# Altium schematic sheet PowerSupply.SchDoc: Evaluation Board 3.2
size A3; Organization: Toradex AG; Address1: Altsagenstrasse 5; Address2: Horw; Address3: 6048; Address4: Switzerland; DocumentNumber: 4; Revision: V3.2; SheetNumber: 4; SheetTotal: 23; PageSetup: Record=PageOptions|CenterHorizontal=True|CenterVertical=True|PrintScale=0.73|XCorrection=1.00|YCorrection=1.00|PrintKind=0|BorderSize=5000000|LeftOffset=0|BottomOffset=0|Orientation=2|PaperLength=1000|PaperWidth=1000|Scale=100|PaperSource=7|PrintQuality=-4|MediaType=1|DitherType=10|PaperKind=A4|PrintScaleMode=1
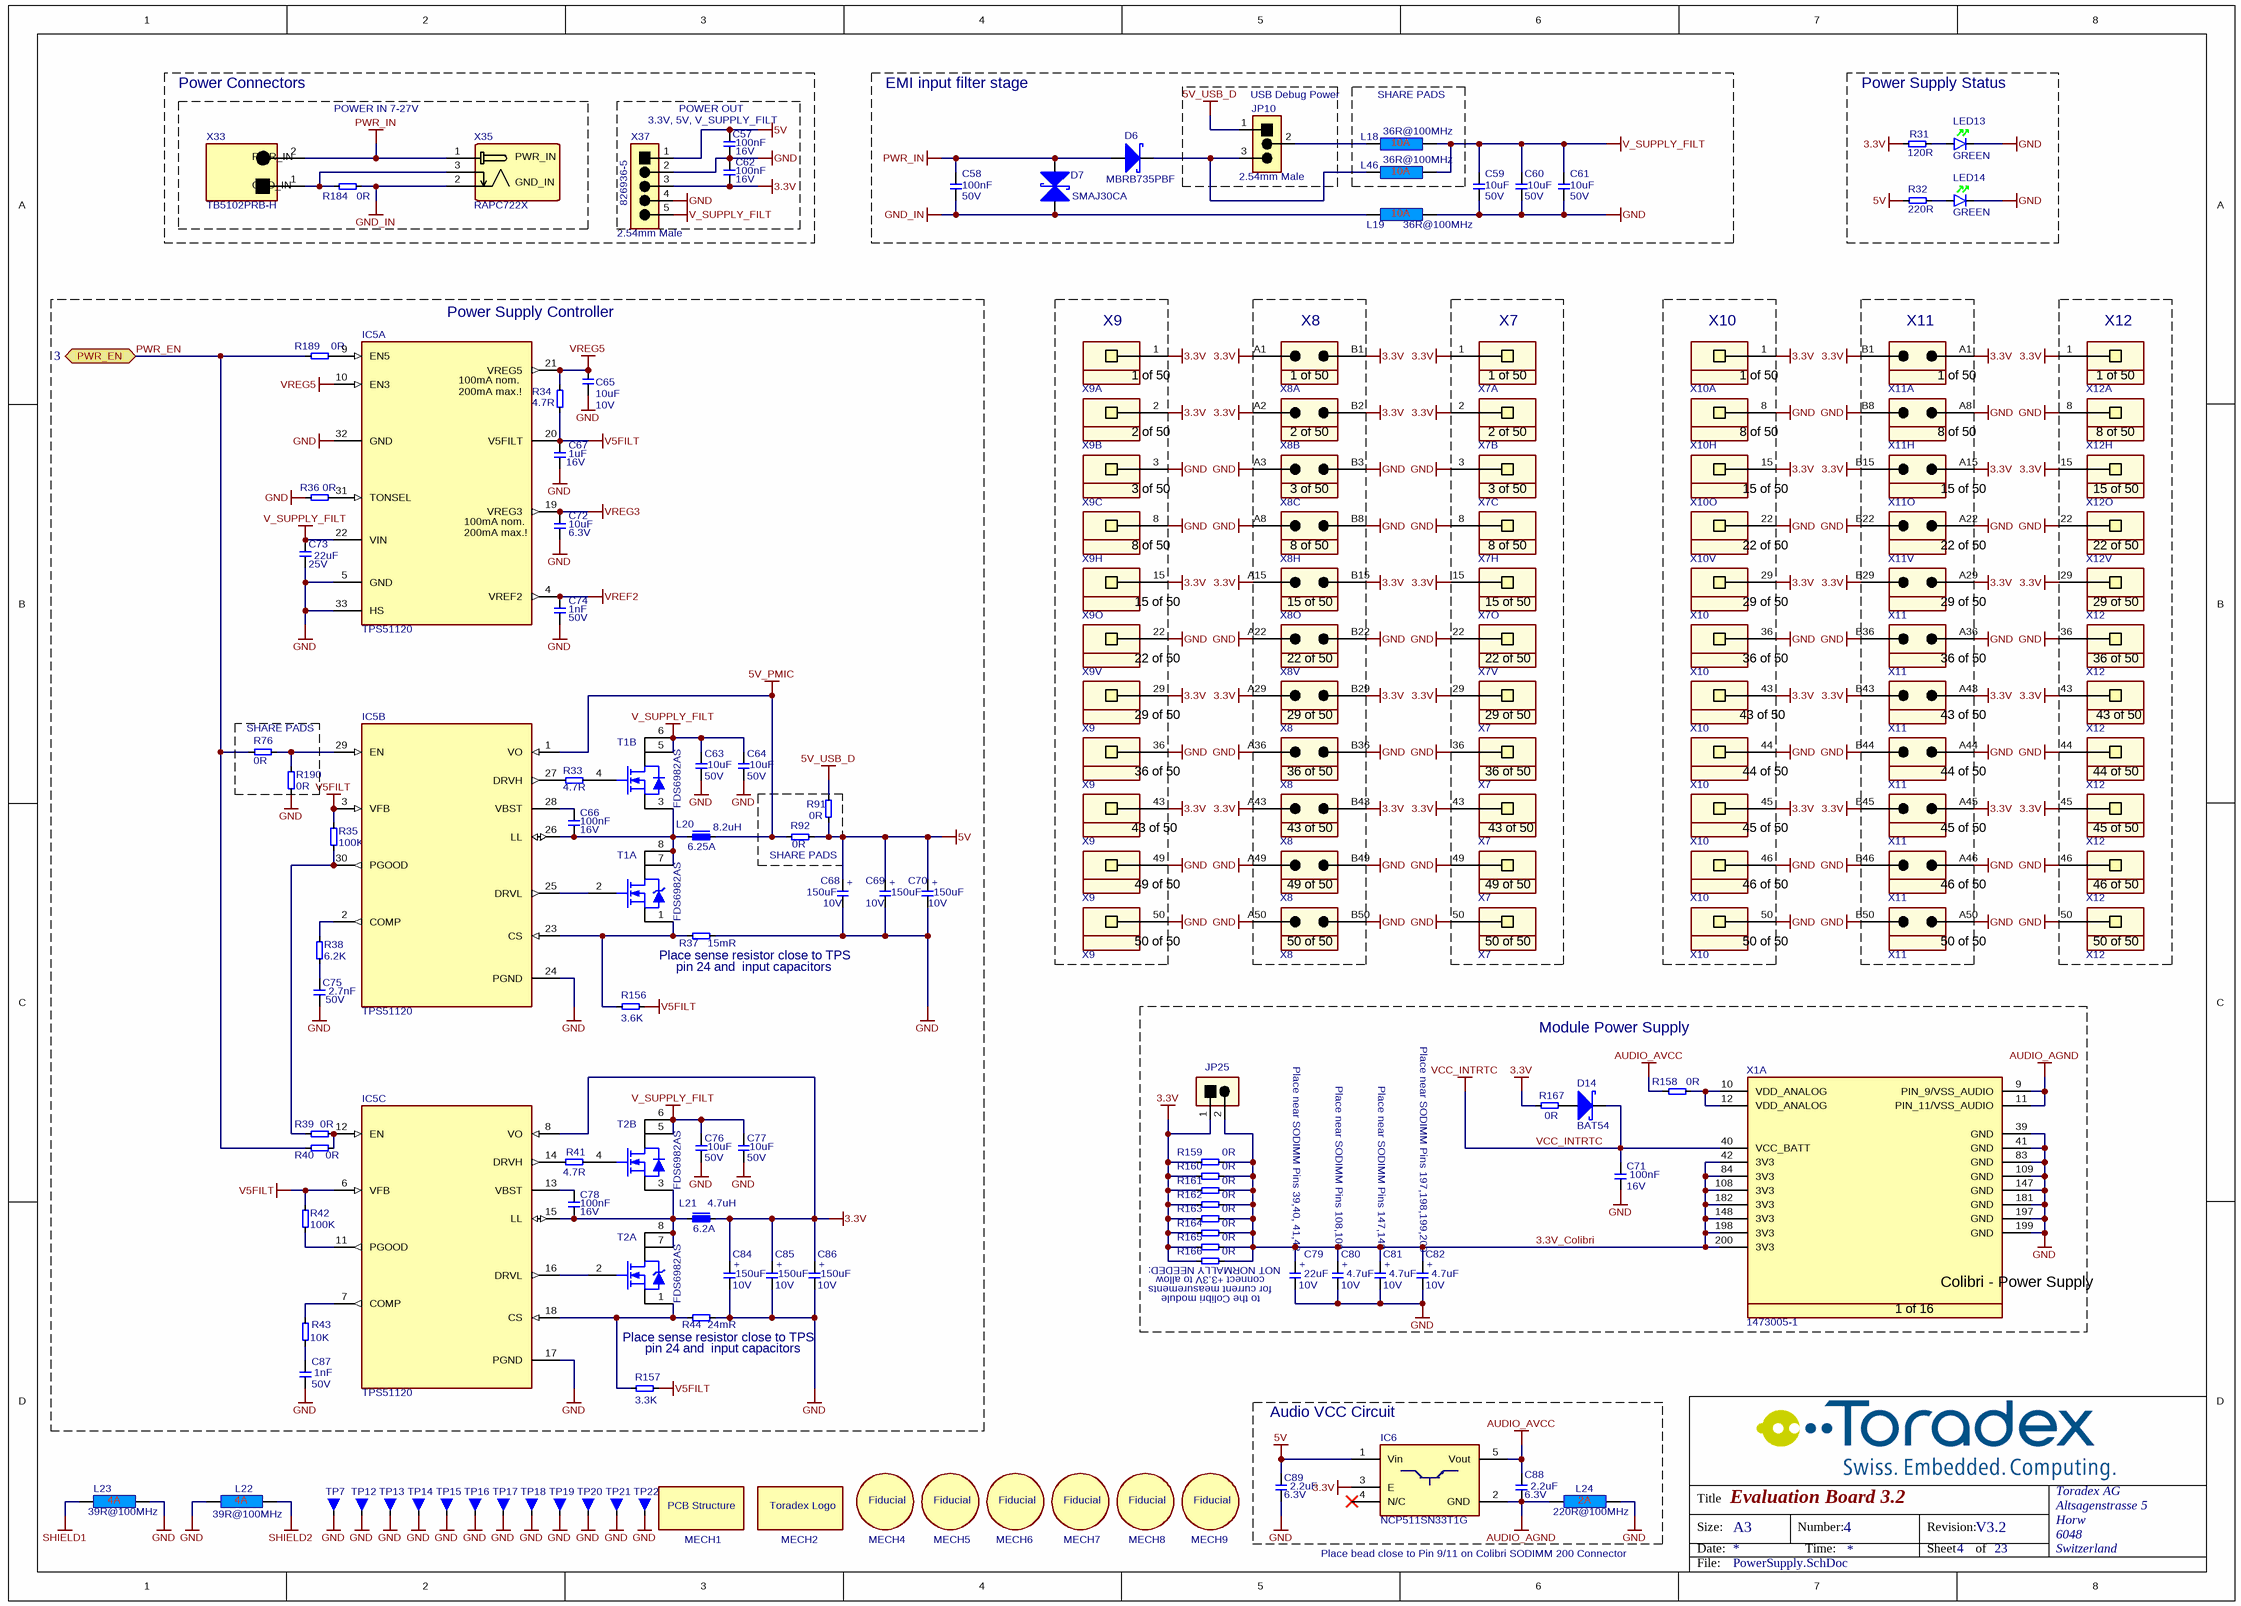
[diagram p0: PowerSupply.SchDoc]

## Parts
C57  Rating: 16V  [T_CAPC0603X33N]  (hidden comment: 100nF)
C58  Rating: 50V  [T_CAPC0603X33N]  (hidden comment: 100nF)
C59  Rating: 50V  [CAPC3225X160N]  (hidden comment: 10uF)
C60  Rating: 50V  [CAPC3225X160N]  (hidden comment: 10uF)
C61  Rating: 50V  [CAPC3225X160N]  (hidden comment: 10uF)
C62  Rating: 16V  [T_CAPC0603X33N]  (hidden comment: 100nF)
C63  Rating: 50V  [CAPC3225X160N]  (hidden comment: 10uF)
C64  Rating: 50V  [CAPC3225X160N]  (hidden comment: 10uF)
C65  Rating: 10V  [T_CAPC0805X125N]  (hidden comment: 10uF)
C66  Rating: 16V  [T_CAPC0603X33N]  (hidden comment: 100nF)
C67  Rating: 16V  [T_CAPC0603X33N]  (hidden comment: 1uF)
C68  Rating: 10V  [CAPMP7343X310N]  (hidden comment: 150uF)
C69  Rating: 10V  [CAPMP7343X310N]  (hidden comment: 150uF)
C70  Rating: 10V  [CAPMP7343X310N]  (hidden comment: 150uF)
C71  Rating: 16V  [T_CAPC0603X33N]  (hidden comment: 100nF)
C72  Rating: 6.3V  [T_CAPC0603X33N]  (hidden comment: 10uF)
C73  Rating: 25V  [CAPC3225X160N]  (hidden comment: 22uF)
C74  Rating: 50V  [T_CAPC0603X33N]  (hidden comment: 1nF)
C75  Rating: 50V  [CAPC1005X60N]  (hidden comment: 2.7nF)
C76  Rating: 50V  [CAPC3225X160N]  (hidden comment: 10uF)
C77  Rating: 50V  [CAPC3225X160N]  (hidden comment: 10uF)
C78  Rating: 16V  [T_CAPC0603X33N]  (hidden comment: 100nF)
C79  Rating: 10V  [CAPMP3528X210N]  (hidden comment: 22uF)
C80  Rating: 10V  [T_CAPMP3216X180N]  (hidden comment: 4.7uF)
C81  Rating: 10V  [T_CAPMP3216X180N]  (hidden comment: 4.7uF)
C82  Rating: 10V  [T_CAPMP3216X180N]  (hidden comment: 4.7uF)
C84  Rating: 10V  [CAPMP7343X310N]  (hidden comment: 150uF)
C85  Rating: 10V  [CAPMP7343X310N]  (hidden comment: 150uF)
C86  Rating: 10V  [CAPMP7343X310N]  (hidden comment: 150uF)
C87  Rating: 50V  [T_CAPC0603X33N]  (hidden comment: 1nF)
C88  Rating: 6.3V  [T_CAPC0603X33N]  (hidden comment: 2.2uF)
C89  Rating: 6.3V  [T_CAPC0603X33N]  (hidden comment: 2.2uF)
D6  MBRB735PBF  [T_VISHAY_MBRB735PBF]
D7  Manufacturer Part No.: SMAJ30CA  [T_LITTLEFUSE_SMAJ30CA]  (hidden comment: D-Littelfuse-SMAJ30CA-Schottky)
D14  BAT54  [SOT95P230X110-3N]
IC5  TPS51120  [QFN50P500X500X100-33N]  (parts A,B,C of 3)
IC6  NCP511SN33T1G  [SOT95P279X142-5N]
JP10  826936-3  [T_TYCO_826936-3]  (value not drawn)
JP25  TSW-101-07-G-D  [T_Samtec_TSW-101-07-G-D]  (value not drawn)
L18  36R@100MHz  [T_Laird_35F0121-0SR-10]
L19  36R@100MHz  [T_Laird_35F0121-0SR-10]
L20  Rating: 6.25A  [T_INDM120120X80N]  (hidden comment: 8.2uH)
L21  Rating: 6.2A  [T_INDM102102X45N]  (hidden comment: 4.7uH)
L22  39R@100MHz  [INDC2013X130N]
L23  39R@100MHz  [INDC2013X130N]
L24  220R@100MHz  [INDC1608X95N]
L46  36R@100MHz  [T_Laird_35F0121-0SR-10]
LED13  Color: GREEN  [T_Osram_T670_GREEN]  (hidden comment: LG T670-K1L2-1)
LED14  Color: GREEN  [T_Osram_T670_GREEN]  (hidden comment: LG T670-K1L2-1)
MECH1  MECH-PCB  [PCB]  (value not drawn)
MECH2  MECH-Toradex_Logo  [T_TORADEX_LOGO]  (value not drawn)
MECH4  MECH-Fiducial  [T_Fiducial]  (value not drawn)
MECH5  MECH-Fiducial  [T_Fiducial]  (value not drawn)
MECH6  MECH-Fiducial  [T_Fiducial]  (value not drawn)
MECH7  MECH-Fiducial  [T_Fiducial]  (value not drawn)
MECH8  MECH-Fiducial  [T_Fiducial]  (value not drawn)
MECH9  MECH-Fiducial  [T_Fiducial]  (value not drawn)
R31  120R  [T_RESC0603X30N]
R32  220R  [T_RESC0603X30N]
R33  4.7R  [RESC1005X40N]
R34  4.7R  [RESC1005X40N]
R35  100K  [T_RESC0603X30N]
R36  0R  [T_RESC0603X30N]
R37  15mR  [RESC3316X76N]
R38  6.2K  [RESC1005X40N]
R39  0R  [T_RESC0603X30N]
R40  0R  [T_RESC0603X30N]
R41  4.7R  [RESC1005X40N]
R42  100K  [T_RESC0603X30N]
R43  10K  [RESC1005X40N]
R44  24mR  [RESC3316X76N]
R76  0R  [T_RESC3216X760N]
R91  0R  [T_RESC3225X30N]
R92  0R  [T_RESC3225X30N]
R156  3.6K  [T_RESC0603X30N]
R157  3.3K  [T_RESC0603X30N]
R158  0R  [T_RESC0603X30N]
R159  0R  [T_RESC3216X760N]
R160  0R  [T_RESC3216X760N]
R161  0R  [T_RESC3216X760N]
R162  0R  [T_RESC3216X760N]
R163  0R  [T_RESC3216X760N]
R164  0R  [T_RESC3216X760N]
R165  0R  [T_RESC3216X760N]
R166  0R  [T_RESC3216X760N]
R167  0R  [T_RESC0603X30N]
R184  0R  [T_RESC3216X760N]
R189  0R  [T_RESC0603X30N]
R190  0R  [T_RESC3216X760N]
T1  FDS6982AS  [SOIC127P600X173-8N]  (parts A,B of 2)
T2  FDS6982AS  [SOIC127P600X173-8N]  (parts A,B of 2)
TP7  5011  [T_TP-THT - EYE]  (value not drawn)
TP12  5011  [T_TP-THT - EYE]  (value not drawn)
TP13  5011  [T_TP-THT - EYE]  (value not drawn)
TP14  5011  [T_TP-THT - EYE]  (value not drawn)
TP15  5011  [T_TP-THT - EYE]  (value not drawn)
TP16  5011  [T_TP-THT - EYE]  (value not drawn)
TP17  5011  [T_TP-THT - EYE]  (value not drawn)
TP18  5011  [T_TP-THT - EYE]  (value not drawn)
TP19  5011  [T_TP-THT - EYE]  (value not drawn)
TP20  5011  [T_TP-THT - EYE]  (value not drawn)
TP21  5011  [T_TP-THT - EYE]  (value not drawn)
TP22  5011  [T_TP-THT - EYE]  (value not drawn)
X1  Manufacturer Part No.: 1473005-1  [T_Tyco_1473005-1]  (hidden comment: CON-Tyco-1473005-1-200-0.6mm)  (part A of 16)
X7  SSW-110-01-G-S  [T_Samtec_SSW-110-01-G-S]  (value not drawn)  (parts A,B,C,H,O,V,29,36,43,49,50 of 50)
X8  TSW-110-07-G-D  [T_Samtec_TSW-110-07-G-D]  (value not drawn)  (parts A,B,C,H,O,V,29,36,43,49,50 of 50)
X9  SSW-110-01-G-S  [T_Samtec_SSW-110-01-G-S]  (value not drawn)  (parts A,B,C,H,O,V,29,36,43,49,50 of 50)
X10  SSW-110-01-G-S  [T_Samtec_SSW-110-01-G-S]  (value not drawn)  (parts A,H,O,V,29,36,43,44,45,46,50 of 50)
X11  TSW-110-07-G-D  [T_Samtec_TSW-110-07-G-D]  (value not drawn)  (parts A,H,O,V,29,36,43,44,45,46,50 of 50)
X12  SSW-110-01-G-S  [T_Samtec_SSW-110-01-G-S]  (value not drawn)  (parts A,H,O,V,29,36,43,44,45,46,50 of 50)
X33  TB5102PRB-H  [T_AUK_TB5102PRB-H]
X35  RAPC722X  [T_DCJ20-0014TB-L]
X37  826936-5  [T_TYCO_826936-5]

## Blocks framed on the sheet
EMI input filter stage: C58-C61 D6 D7 JP10 L19
Power Supply Status: LED13 LED14 R31 R32
Power Connectors: R184 X33 X35
SHARE PADS: L18 L46
Power Supply Controller: C63-C70 C72-C78 C84-C87 IC5 L20 L21 R33-R44 R156 R157 R189 T1 T2
X9: X9
X8: X8
X7: X7
X10: X10
X11: X11
X12: X12
SHARE PADS: R76 R190
SHARE PADS: R91 R92
Module Power Supply: C71 C79-C82 D14 JP25 R158-R167 X1
Audio VCC Circuit: C88 C89 IC6 L24

## Ports
PWR_EN (bidir, see 3)

## Nets
3.3V: C62.1 C84.1 C85.1 C86.1 IC5.8(VO) IC6.3(E) JP25.1 L21.2 R31.1 R159.1 R160.1 R161.1 R162.1 R163.1 R164.1 R165.1 R166.1 R167.1 X7.1 X7.2 X7.15 X7.29 X7.43 X8.A1 X8.A2 X8.A15 X8.A29 X8.A43 X8.B1 X8.B2 X8.B15 X8.B29 X8.B43 X9.1 X9.2 X9.15 X9.29 X9.43 X10.1 X10.15 X10.29 X10.43 X10.45 X11.A1 X11.A15 X11.A29 X11.A43 X11.A45 X11.B1 X11.B15 X11.B29 X11.B43 X11.B45 X12.1 X12.15 X12.29 X12.43 X12.45 X37.3
5V: C57.2 C68.1 C69.1 C70.1 C89.2 IC6.1(Vin) R32.1 R91.2 R92.2 X37.1
5V_PMIC: IC5.1(VO) L20.2 R92.1
5V_USB_D: JP10.1 R91.1
AUDIO_AGND: C88.1 IC6.2(GND) L24.1 X1.9(PIN_9/VSS_AUDIO) X1.11(PIN_11/VSS_AUDIO)
AUDIO_AVCC: C88.2 IC6.5(Vout) R158.1
GND: C57.1 C59.1 C60.1 C61.1 C62.2 C63.1 C64.1 C65.1 C67.1 C68.2 C69.2 C70.2 C71.1 C72.1 C73.1 C74.1 C75.1 C76.1 C77.1 C79.2 C80.2 C81.2 C82.2 C84.2 C85.2 C86.2 C87.1 C89.1 IC5.5(GND) IC5.17(PGND) IC5.24(PGND) IC5.32(GND) IC5.33(HS) L19.2 L22.1 L23.2 L24.2 LED13.K LED14.K R36.1 R37.2 R44.2 R190.1 TP7.1 TP12.1 TP13.1 TP14.1 TP15.1 TP16.1 TP17.1 TP18.1 TP19.1 TP20.1 TP21.1 TP22.1 X1.39(GND) X1.41(GND) X1.83(GND) X1.109(GND) X1.147(GND) X1.181(GND) X1.197(GND) X1.199(GND) X7.3 X7.8 X7.22 X7.36 X7.49 X7.50 X8.A3 X8.A8 X8.A22 X8.A36 X8.A49 X8.A50 X8.B3 X8.B8 X8.B22 X8.B36 X8.B49 X8.B50 X9.3 X9.8 X9.22 X9.36 X9.49 X9.50 X10.8 X10.22 X10.36 X10.44 X10.46 X10.50 X11.A8 X11.A22 X11.A36 X11.A44 X11.A46 X11.A50 X11.B8 X11.B22 X11.B36 X11.B44 X11.B46 X11.B50 X12.8 X12.22 X12.36 X12.44 X12.46 X12.50 X37.2 X37.4
GND_IN: C58.1 D7.2(Anode) L19.1 R184.2 X35.2(PWR_IN)
PWR_IN: C58.2 D6.3 D7.1(Cathode) X33.2(PWR_IN) X35.1(GND_IN)
SHIELD1: L23.1
SHIELD2: L22.2
V5FILT: C67.2 IC5.3(VFB) IC5.6(VFB) IC5.20(V5FILT) R34.1 R35.2 R42.2 R156.2 R157.2
V_SUPPLY_FILT: C59.2 C60.2 C61.2 C63.2 C64.2 C73.2 C76.2 C77.2 IC5.22(VIN) L18.2 L46.2 T1.5(D) T1.6(D) T2.5(D) T2.6(D) X37.5
VCC_INTRTC: C71.2 D14.3 X1.40(VCC_BATT)
VREF2: C74.2 IC5.4(VREF2)
VREG3: C72.2 IC5.19(VREG3)
VREG5: C65.2 IC5.10(EN3) IC5.21(VREG5) R34.2
3.3V_Colibri: C79.1 C80.1 C81.1 C82.1 JP25.2 R159.2 R160.2 R161.2 R162.2 R163.2 R164.2 R165.2 R166.2 X1.42(3V3) X1.84(3V3) X1.108(3V3) X1.148(3V3) X1.182(3V3) X1.198(3V3) X1.200(3V3)
PWR_EN: R40.1 R76.1 R189.1 ; port PWR_EN
NetC66_1: C66.1 IC5.26(LL) L20.1 T1.3(S) T1.7(D) T1.8(D)
NetC66_2: C66.2 IC5.28(VBST)
NetC75_2: C75.2 R38.1
NetC78_1: C78.1 IC5.15(LL) L21.1 T2.3(S) T2.7(D) T2.8(D)
NetC78_2: C78.2 IC5.13(VBST)
NetC87_2: C87.2 R43.1
NetD6_2: D6.2 JP10.3 L46.1
NetD14_1: D14.1 R167.2
NetIC5_2: IC5.2(COMP) R38.2
NetIC5_7: IC5.7(COMP) R43.2
NetIC5_9: IC5.9(EN5) R189.2
NetIC5_11: IC5.11(PGOOD) R42.1
NetIC5_12: IC5.12(EN) R39.2 R40.2
NetIC5_14: IC5.14(DRVH) R41.1
NetIC5_16: IC5.16(DRVL) T2.2(G)
NetIC5_18: IC5.18(CS) R44.1 R157.1 T2.1(S)
NetIC5_23: IC5.23(CS) R37.1 R156.1 T1.1(S)
NetIC5_25: IC5.25(DRVL) T1.2(G)
NetIC5_27: IC5.27(DRVH) R33.1
NetIC5_29: IC5.29(EN) R76.2 R190.2
NetIC5_30: IC5.30(PGOOD) R35.1 R39.1
NetIC5_31: IC5.31(TONSEL) R36.2
NetJP10_2: JP10.2 L18.1
NetLED13_A: LED13.A R31.2
NetLED14_A: LED14.A R32.2
NetR33_2: R33.2 T1.4(G)
NetR41_2: R41.2 T2.4(G)
NetR158_2: R158.2 X1.10(VDD_ANALOG) X1.12(VDD_ANALOG)
NetR184_1: R184.1 X33.1(GND_IN) X35.3(PWR_IN)

Not connected (* = marked no-connect by the designer): IC6 4(N/C)*

## Notes on the sheet
- POWER IN 7-27V
- (near C57) 3.3V, 5V, V_SUPPLY_FILT
- (near C57) POWER OUT
- (near JP10) USB Debug Power
- (near JP10) 2.54mm Male
- (near X37) 2.54mm Male
- (near R37) Place sense resistor close to TPS
- (near R37) pin 24 and  input capacitors
- Place near SODIMM Pins 197,198,199,200
- (near C79) Place near SODIMM Pins 39,40, 41,42
- Place near SODIMM Pins 108,109
- Place near SODIMM Pins 147,148
- (near R166) connect +3.3V to allow
- (near R166) NOT NORMALLY NEEDED:
- (near R44) Place sense resistor close to TPS
- to the Colibri module
- for current measurements
- pin 24 and  input capacitors
- Place bead close to Pin 9/11 on Colibri SODIMM 200 Connector
- Title
- Size:
- Date:
- A3
- Number:
- Time:
- Revision:
- Sheet
- of
- File:
- (in symbol C-TA-4.7uF-10V-20%-3216) +
- (in symbol C-TA-22uF-10V-20%-3528) +
- (in symbol C-TA-150uF-10V-10%-7343) +
- (in symbol CON-Samtec-SSW-110-01-G-S, part A) 1 of 50
- (in symbol CON-Samtec-SSW-110-01-G-S, part B) 2 of 50
- (in symbol CON-Samtec-SSW-110-01-G-S, part C) 3 of 50
- (in symbol CON-Samtec-SSW-110-01-G-S, part H) 8 of 50
- (in symbol CON-Samtec-SSW-110-01-G-S, part O) 15 of 50
- (in symbol CON-Samtec-SSW-110-01-G-S, part V) 22 of 50
- (in symbol CON-Samtec-SSW-110-01-G-S, part 29) 29 of 50
- (in symbol CON-Samtec-SSW-110-01-G-S, part 36) 36 of 50
- (in symbol CON-Samtec-SSW-110-01-G-S, part 43) 43 of 50
- (in symbol CON-Samtec-SSW-110-01-G-S, part 44) 44 of 50
- (in symbol CON-Samtec-SSW-110-01-G-S, part 45) 45 of 50
- (in symbol CON-Samtec-SSW-110-01-G-S, part 46) 46 of 50
- (in symbol CON-Samtec-SSW-110-01-G-S, part 49) 49 of 50
- (in symbol CON-Samtec-SSW-110-01-G-S, part 50) 50 of 50
- (in symbol CON-Samtec-TSW-110-07-G-D, part A) 1 of 50
- (in symbol CON-Samtec-TSW-110-07-G-D, part B) 2 of 50
- (in symbol CON-Samtec-TSW-110-07-G-D, part C) 3 of 50
- (in symbol CON-Samtec-TSW-110-07-G-D, part H) 8 of 50
- (in symbol CON-Samtec-TSW-110-07-G-D, part O) 15 of 50
- (in symbol CON-Samtec-TSW-110-07-G-D, part V) 22 of 50
- (in symbol CON-Samtec-TSW-110-07-G-D, part 29) 29 of 50
- (in symbol CON-Samtec-TSW-110-07-G-D, part 36) 36 of 50
- (in symbol CON-Samtec-TSW-110-07-G-D, part 43) 43 of 50
- (in symbol CON-Samtec-TSW-110-07-G-D, part 44) 44 of 50
- (in symbol CON-Samtec-TSW-110-07-G-D, part 45) 45 of 50
- (in symbol CON-Samtec-TSW-110-07-G-D, part 46) 46 of 50
- (in symbol CON-Samtec-TSW-110-07-G-D, part 49) 49 of 50
- (in symbol CON-Samtec-TSW-110-07-G-D, part 50) 50 of 50
- (in symbol CON-Tyco-1473005-1-200-0.6mm, part A) Colibri - Power Supply; 1 of 16
- (in symbol IC-TI-TPS51120, part A) 100mA nom.; 200mA max.!
- (in symbol MECH-Toradex_Logo) Toradex Logo

## Library data of the parts
C57 C62 C66 C71 C78 = C-X7R-100nF-16V-10%-0603: Capacitor Ceramic X7R 100nF 16V 10% 0603; Tolerance: 10%; Type: X7R; Value: 100nF
C58 = C-X7R-100nF-50V-20%-0603: Capacitor Ceramic X7R 100nF 50V 20% 0603; Tolerance: 20%; Type: X7R; Value: 100nF
C59-C61 C63 C64 C76 C77 = C-X5R-10uF-50V-20%-1210: Capacitor Ceramic X5R 10uF 50V 20% 1210; Tolerance: 20%; Type: X5R; Value: 10uF
C65 = C-X5R-10uF-10V-20%-0805: Capacitor Ceramic X5R 10uF 10V 20% 0805; Tolerance: 20%; Type: X5R; Value: 10uF
C67 = C-X5R-1uF-16V-20%-0603: Capacitor Ceramic X5R 1uF 16V 20% 0603; Tolerance: 20%; Type: X5R; Value: 1uF
C68-C70 C84-C86 = C-TA-150uF-10V-10%-7343: Capacitor TA 150uF 10V 20% 7343; Tolerance: 10%; Type: TA; Value: 150uF
C72 = C-X5R-10uF-6.3V-20%-0603: Capacitor Ceramic X5R 10uF 6.3V 20% 0603; Tolerance: 20%; Type: X5R; Value: 10uF
C73 = C-X5R-22uF-25V-20%-1210: Capacitor Ceramic X5R 22uF 25V 20% 1210; Tolerance: 20%; Type: X5R; Value: 22uF
C74 C87 = C-X7R-1nF-50V-10%-0603: Capacitor Ceramic X7R 1nF 50V 10% 0603; Tolerance: 10%; Type: X7R; Value: 1nF
C75 = C-X7R-2.7nF-50V-10%-0402: Capacitor Ceramic X7R 2.7nF 50V 10% 0402; Tolerance: 10%; Type: X7R; Value: 2.7nF
C79 = C-TA-22uF-10V-20%-3528: Capacitor TA 22uF 10V 20% 3528; Tolerance: 20%; Type: TA; Value: 22uF
C80-C82 = C-TA-4.7uF-10V-20%-3216: Capacitor TA 4.7uF 10V 20% 3216; Tolerance: 20%; Type: TA; Value: 4.7uF
C88 C89 = C-X5R-2.2uF-6.3V-20%-0603: Capacitor Ceramic X5R 2.2uF 6.3V 20% 0603; Tolerance: 20%; Type: X5R; Value: 2.2uF
D6 = D-VISHAY-MBRB735PBF: MBRB735PBF Schottky Diode; Manufacturer Name: Vishay; Manufacturer Part No.: MBRB735PBF
D7 = D-Littelfuse-SMAJ30CA-Schottky: Bidirectional ESD protection; Manufacturer Name: Littelfuse
D14 = D-Philips-BAT54-Schottky: BAT54 Schottky Diode; Manufacturer Name: Philips; Manufacturer Part No.: BAT54
IC5 = IC-TI-TPS51120: Power Supply Controller; Manufacturer Name: Texas Instruments; Manufacturer Part No.: TPS51120
IC6 = IC-ON-NCP511SN33T1G: NCP511SN33T1G LDO Regulator; Manufacturer Name: ON Semiconductor; Manufacturer Part No.: NCP511SN33T1G
JP10 = CON-Tyco-826936-3-1X3-2.54mm-JP_1: Jumper, 3-Pin; Manufacturer Name: Tyco; No. of ways: 1X3; Pitch: 2.54mm; Manufacturer Part No.: 826936-3
JP25 = CON-Samtec-TSW-101-07-G-D: Header male, 1x2 Pins, 2.54 mm pitch; Manufacturer Name: Samtec; Pitch: 2.54 mm; No. of ways: 1x2; Manufacturer Part no.: TSW-101-07-G-D
L18 L19 L46 = L-Laird-35F0121-0SR-10-10A-25%: Power Supply FB 10A; Tolerance: 25%; Rating: 10A; Value: 36R@100MHz
L20 = L-Wurth-744771008-8.2uH-6.25A-20%: Inductance 8.2uH 6.25A 20%; Manufacturer Name: Wurth; Tolerance: 20%; Manufacturer Part No.: 744771008; Value: 8.2uH
L21 = L-Wurth-7447797470-4.7uH-6.2A-20%: Inductance 4.7uH 6.2A 20%; Manufacturer Name: Wurth; Tolerance: 20%; Manufacturer Part No.: 7447797470; Value: 4.7uH
L22 L23 = L-Panasonic-EXC-ML20A390U-39R@100MHz-4A-25%-0805: 39R@100MHz 4A EMI FILTER; Tolerance: 25%; Rating: 4A; Manufacturer Name: Panasonic; Manufacturer Name: EXC-ML20A390U; Value: 39R@100MHz
L24 = L-220R@100MHz-2A-25%-0603: 220R@100MHz 2A EMI FILTER; Tolerance: 25%; Rating: 2A; Value: 220R@100MHz
LED13 LED14 = LED-Osram-T670-K1L2-1: LED green Osram LG T670-K1L2-1; Manufacturer Name: Osram; Manufacturer Part N.: LG T670-K1L2-1
MECH1 = MECH-PCB: PCB Structure
MECH2 = MECH-Toradex_Logo: Toradex_Logo
MECH4-MECH9 = MECH-Fiducial: Fiducial
R31 = R-120R-63mW-5%-0603: Resistor 120 ohm 63mW 5% 0603; Rating: 63mW; Tolerance: 5%; Value: 120R
R32 = R-220R-63mW-5%-0603: Resistor 220 ohm 63mW 5% 0603; Rating: 63mW; Tolerance: 5%; Value: 220R
R33 R34 R41 = R-4.7R-63mW-5%-0402: Resistor 4.7 ohm 63mW 5% 0402; Rating: 63mW; Tolerance: 5%; Value: 4.7R
R35 R42 = R-100KR-63mW-5%-0603: Resistor 100 Kohm 63mW 5% 0603; Value: 100KR; Rating: 63mW; Tolerance: 5%
R36 R39 R40 R158 R167 R189 = R-0R-63mW-1%-0603: Resistor 0 ohm 63mW 1% 0603; Rating: 63mW; Tolerance: 1%; Value: 0R
R37 = R-15mR-250mW-1%-1206: Resistor 15 mohm 250mW 1% 1206; Rating: 250mW; Tolerance: 1%; Value: 15mR
R38 = R-6.2KR-63mW-1%-0402: Resistor 6.2 Kohm 63mW 1% 0402; Value: 6.2KR; Rating: 63mW; Tolerance: 1%
R43 = R-10KR-63mW-1%-0402: Resistor 10 Kohm 63mW 1% 0402; Value: 10KR; Rating: 63mW; Tolerance: 1%
R44 = R-24mR-250mW-1%-1206: Resistor 24 mohm 250mW 1% 1206; Rating: 250mW; Tolerance: 1%; Value: 24mR
R76 R159-R166 R184 R190 = R-0R-63mW-1%-1206: Resistor 0 ohm 63mW 1% 1206; Rating: 63mW; Tolerance: 1%; Value: 0R
R91 R92 = R-0R-63mW-1%-1210: Resistor 0 ohm 63mW 1% 1210; Rating: 63mW; Tolerance: 1%; Value: 0R
R156 = R-3.6KR-63mW-1%-0603: Resistor 3.6 Kohm 63mW 1% 0603; Value: 3.6KR; Rating: 63mW; Tolerance: 1%
R157 = R-3.3KR-63mW-1%-0603: Resistor 3.3 Kohm 63mW 1% 0603; Value: 3.3KR; Rating: 63mW; Tolerance: 1%
T1 T2 = T-Fairchild-FDS6982AS-N: N-Channel PowerTrench SyncFET; Manufacturer Name: Fairchild; Manufacturer Part No.: FDS6982AS
TP7 TP12-TP22 = TP-Keystone-5011: Testpin Eye TH; Manufacturere Name: Keystone; Manufacturere Part No.: 5011
X1 = CON-Tyco-1473005-1-200-0.6mm: SODIMM Connector; Manufacturer Name: Tyco; No. of ways: 200
X7 X9 X10 X12 = CON-Samtec-SSW-110-01-G-S: Header 1x50 pin 2.54mm pitch; Manufacturer Name: Samtec; Pitch: 2.54mm; No. of ways: 1x50; Manufacturer Part No.: SSW-110-01-G-S
X8 X11 = CON-Samtec-TSW-110-07-G-D: Header 2x50 pin 2.54mm pitch; Manufacturer Name: Samtec; Pitch: 2.54mm; No. of ways: 2x50; Manufacturer Part No.: TSW-110-07-G-D
X33 = CON-AUK-TB5102PRB-H-1x2-50.8mm: Power Connector; Manufacturer Name: AUK; No. of ways: 1x2; Pitch: 5.08mm; Manufacturer Part No.: TB5102PRB-H
X35 = CON-SWC-RAPC722X: Power Jack; Manufacturer Name: SWC; Manufacturer Part No.: RAPC722X
X37 = CON-Tyco-826936-5-1X4-2.54mm: Header, 5-Pin; Manufacturer Name: Tyco; No. of ways: 1X5; Pitch: 2.54mm; Manufacturer Part No.: 826936-5